# EasyEDA Pro project ProPrj_Avaota A1 八核 AIoT 开发板_2024-05-03.epro, schematic Avaota Pi A, sheets 6 to 13 of 13 (continued)
## Sheets (continued)
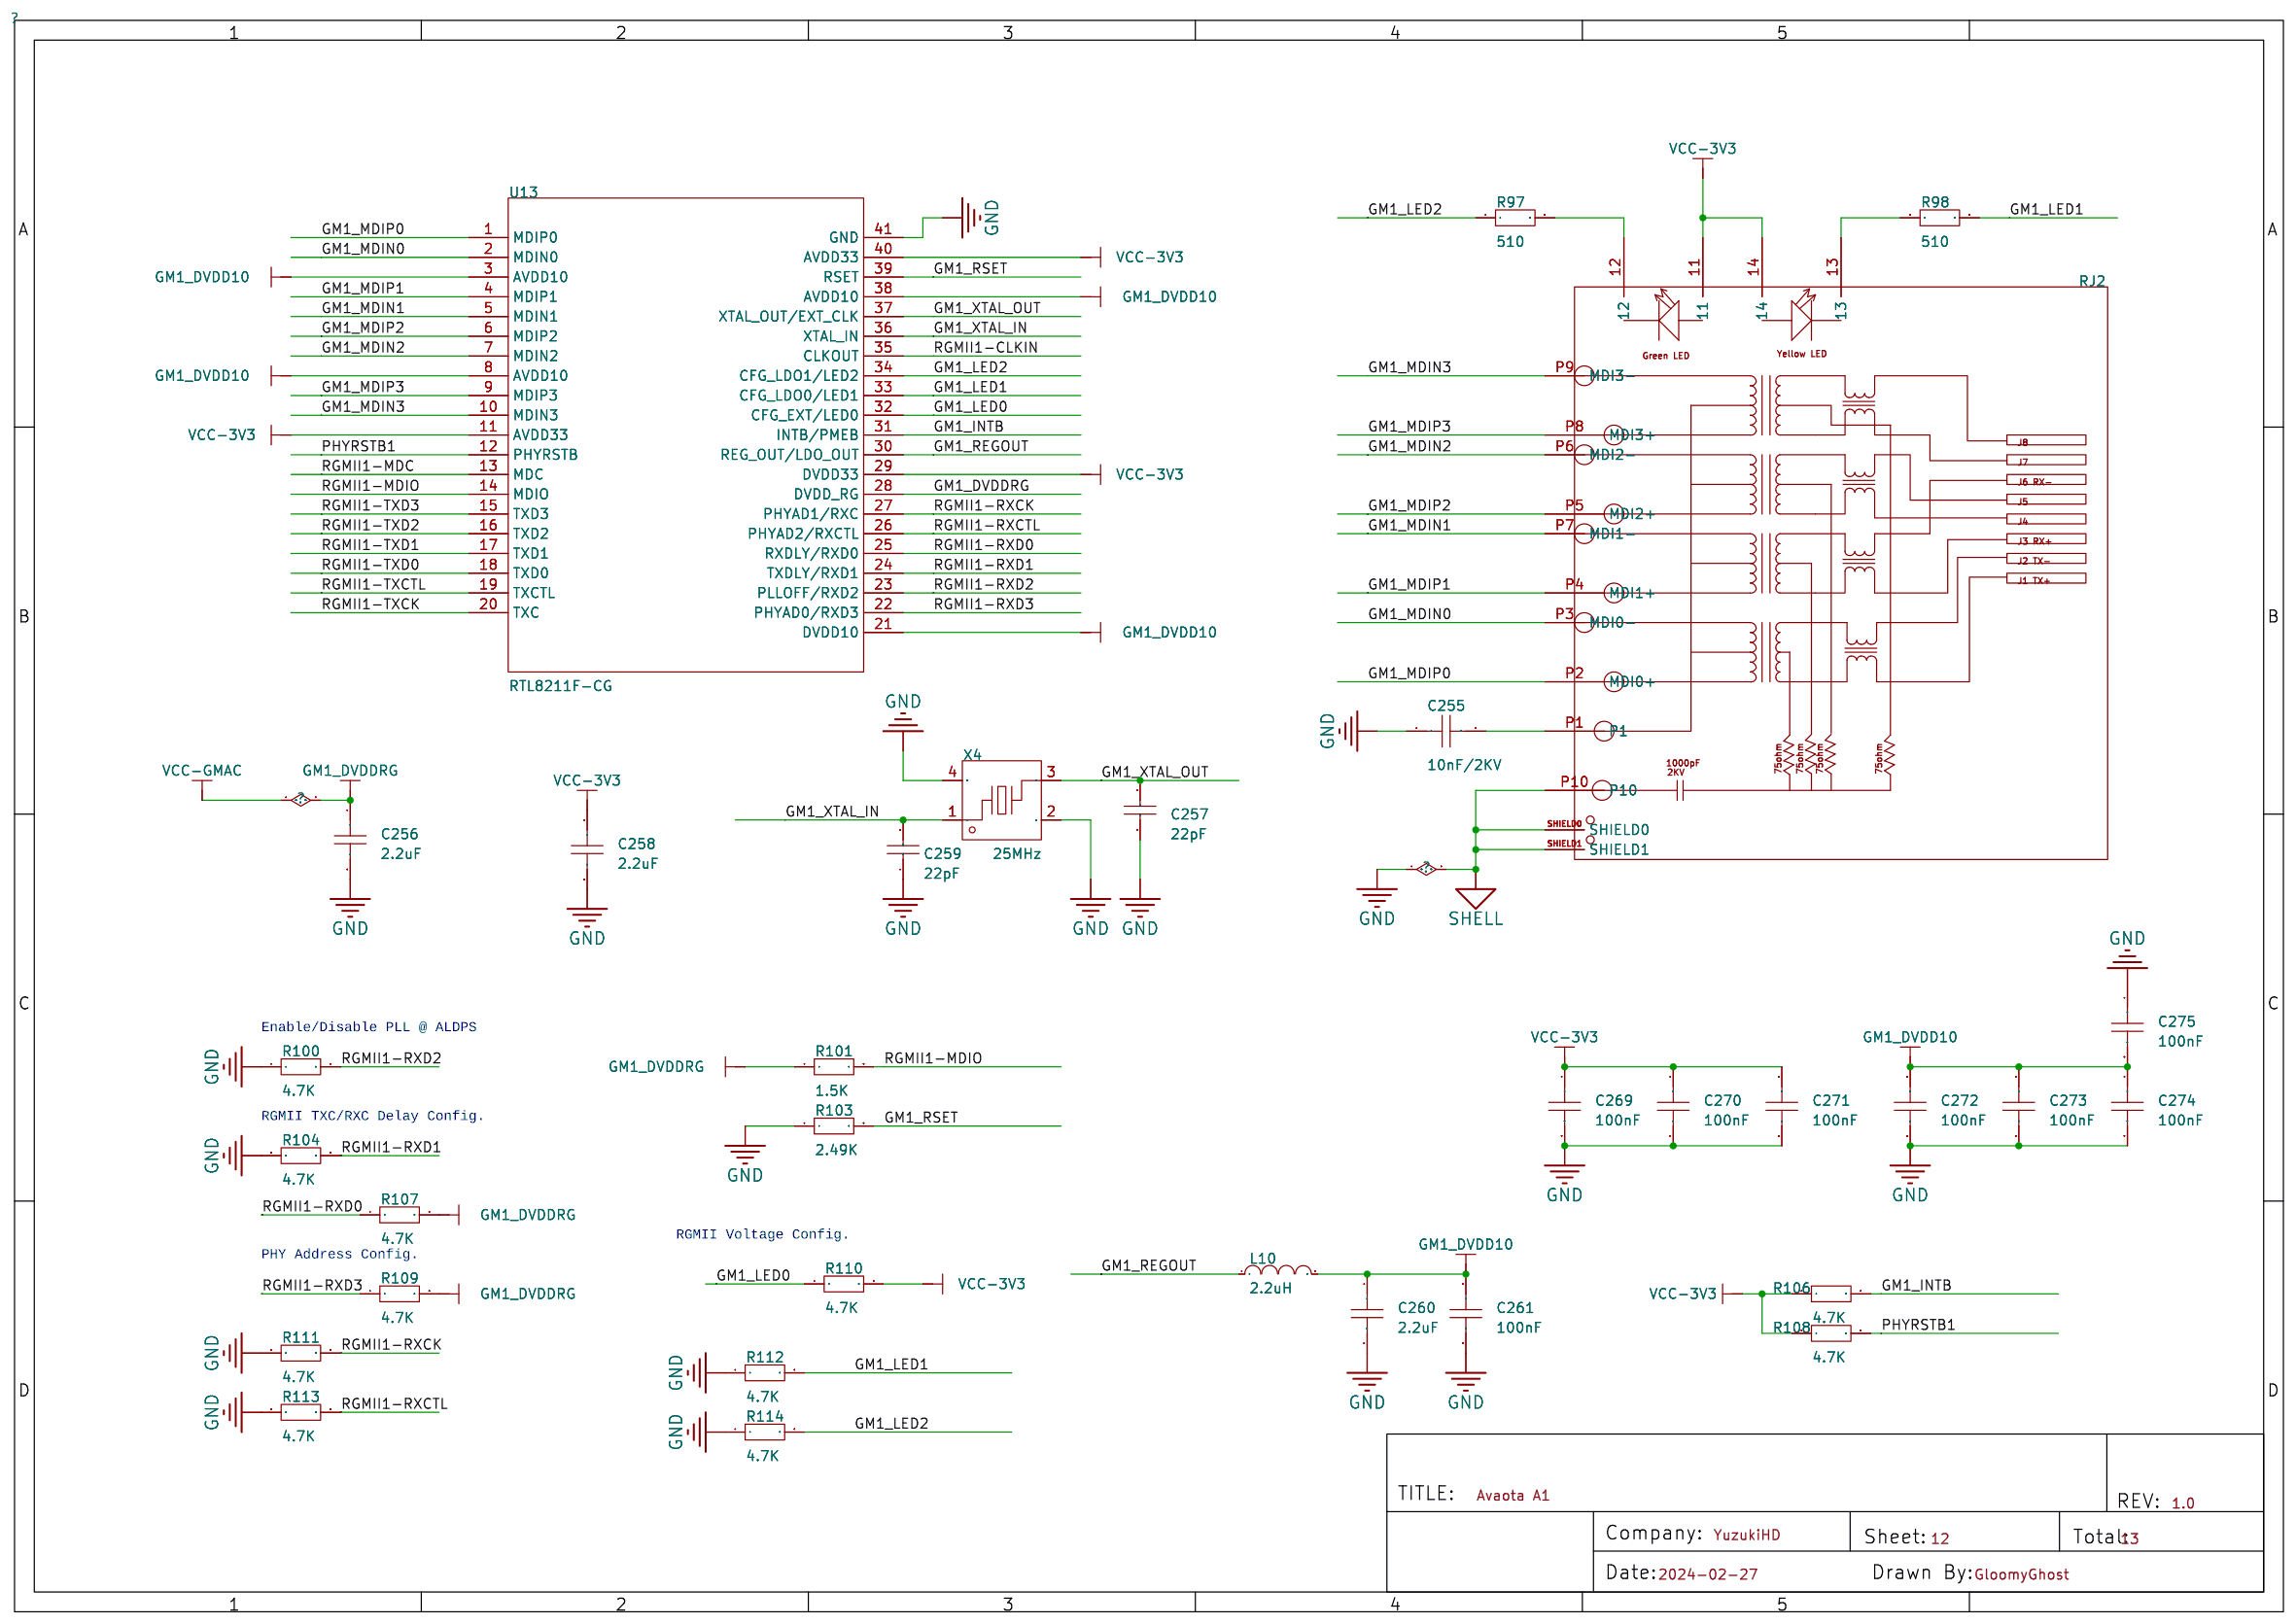
[diagram p9: GMAC1]
11 12VDC
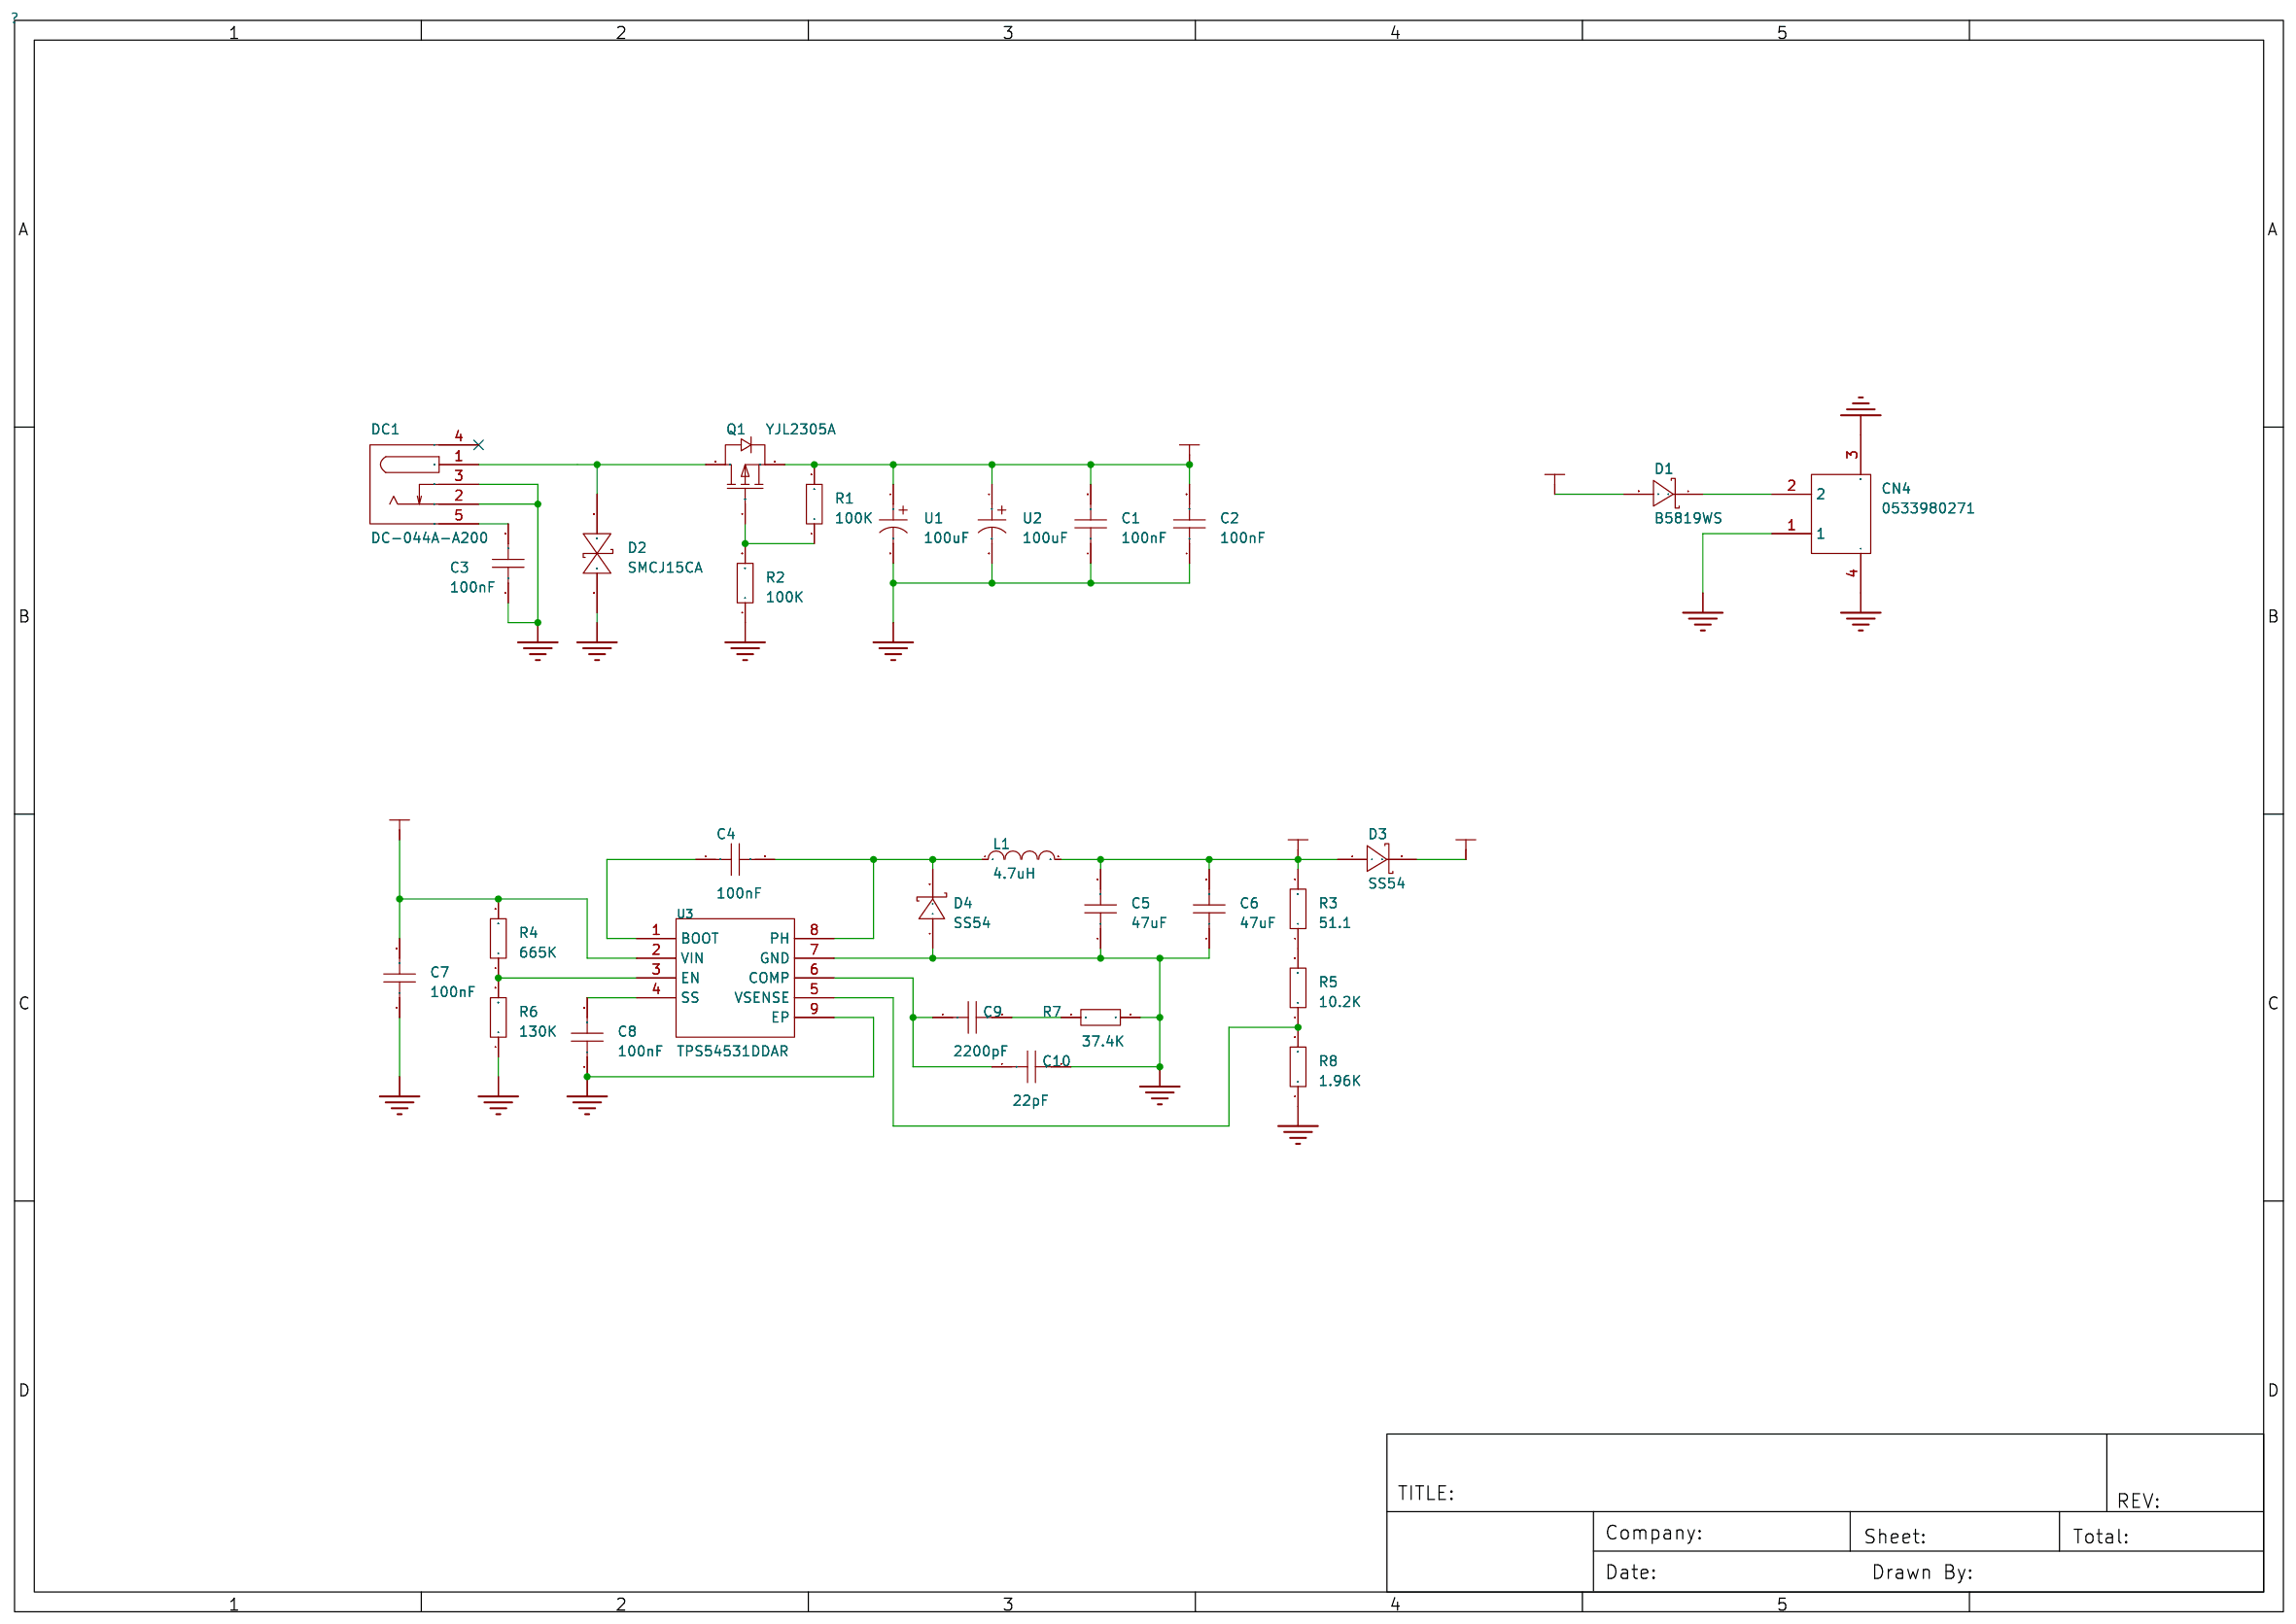
[diagram p10: 12VDC]
12 PERF3
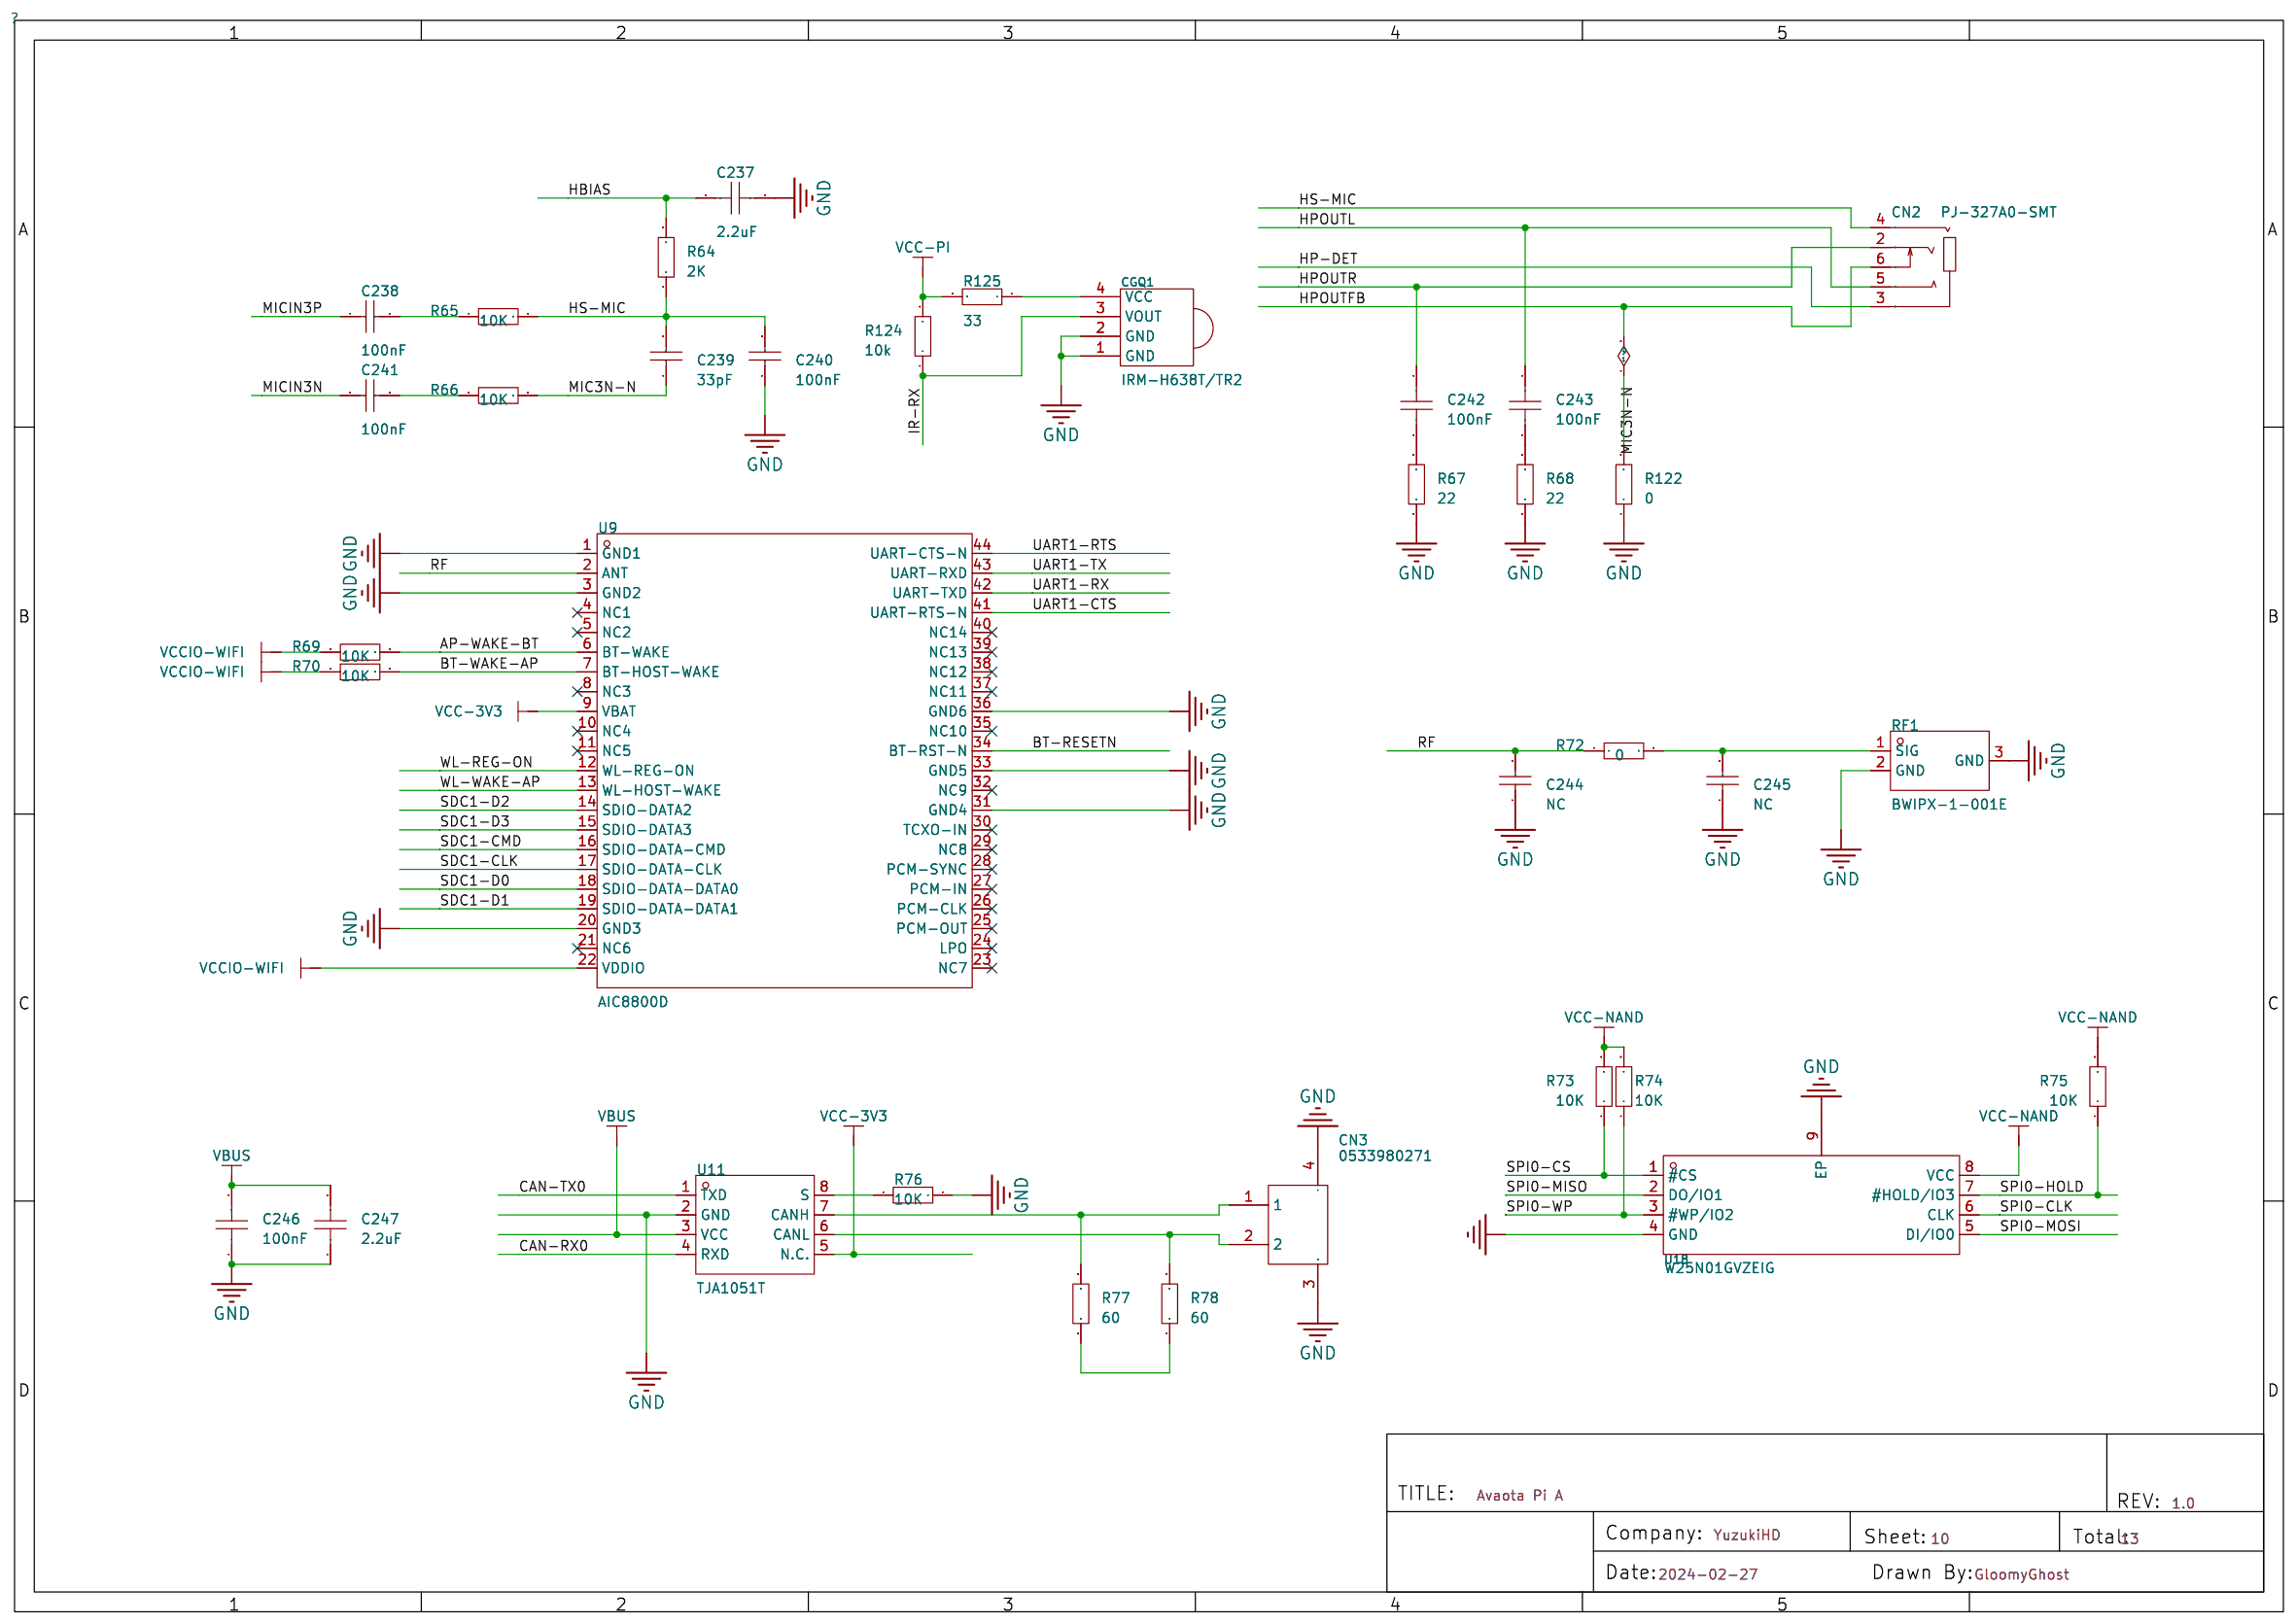
[diagram p11: PERF3]
13 CAMERA